# EasyEDA Pro project BlueberryPi.eprj, schematic BlueberryPi Board, sheets 1 to 8 of 13 (continued)
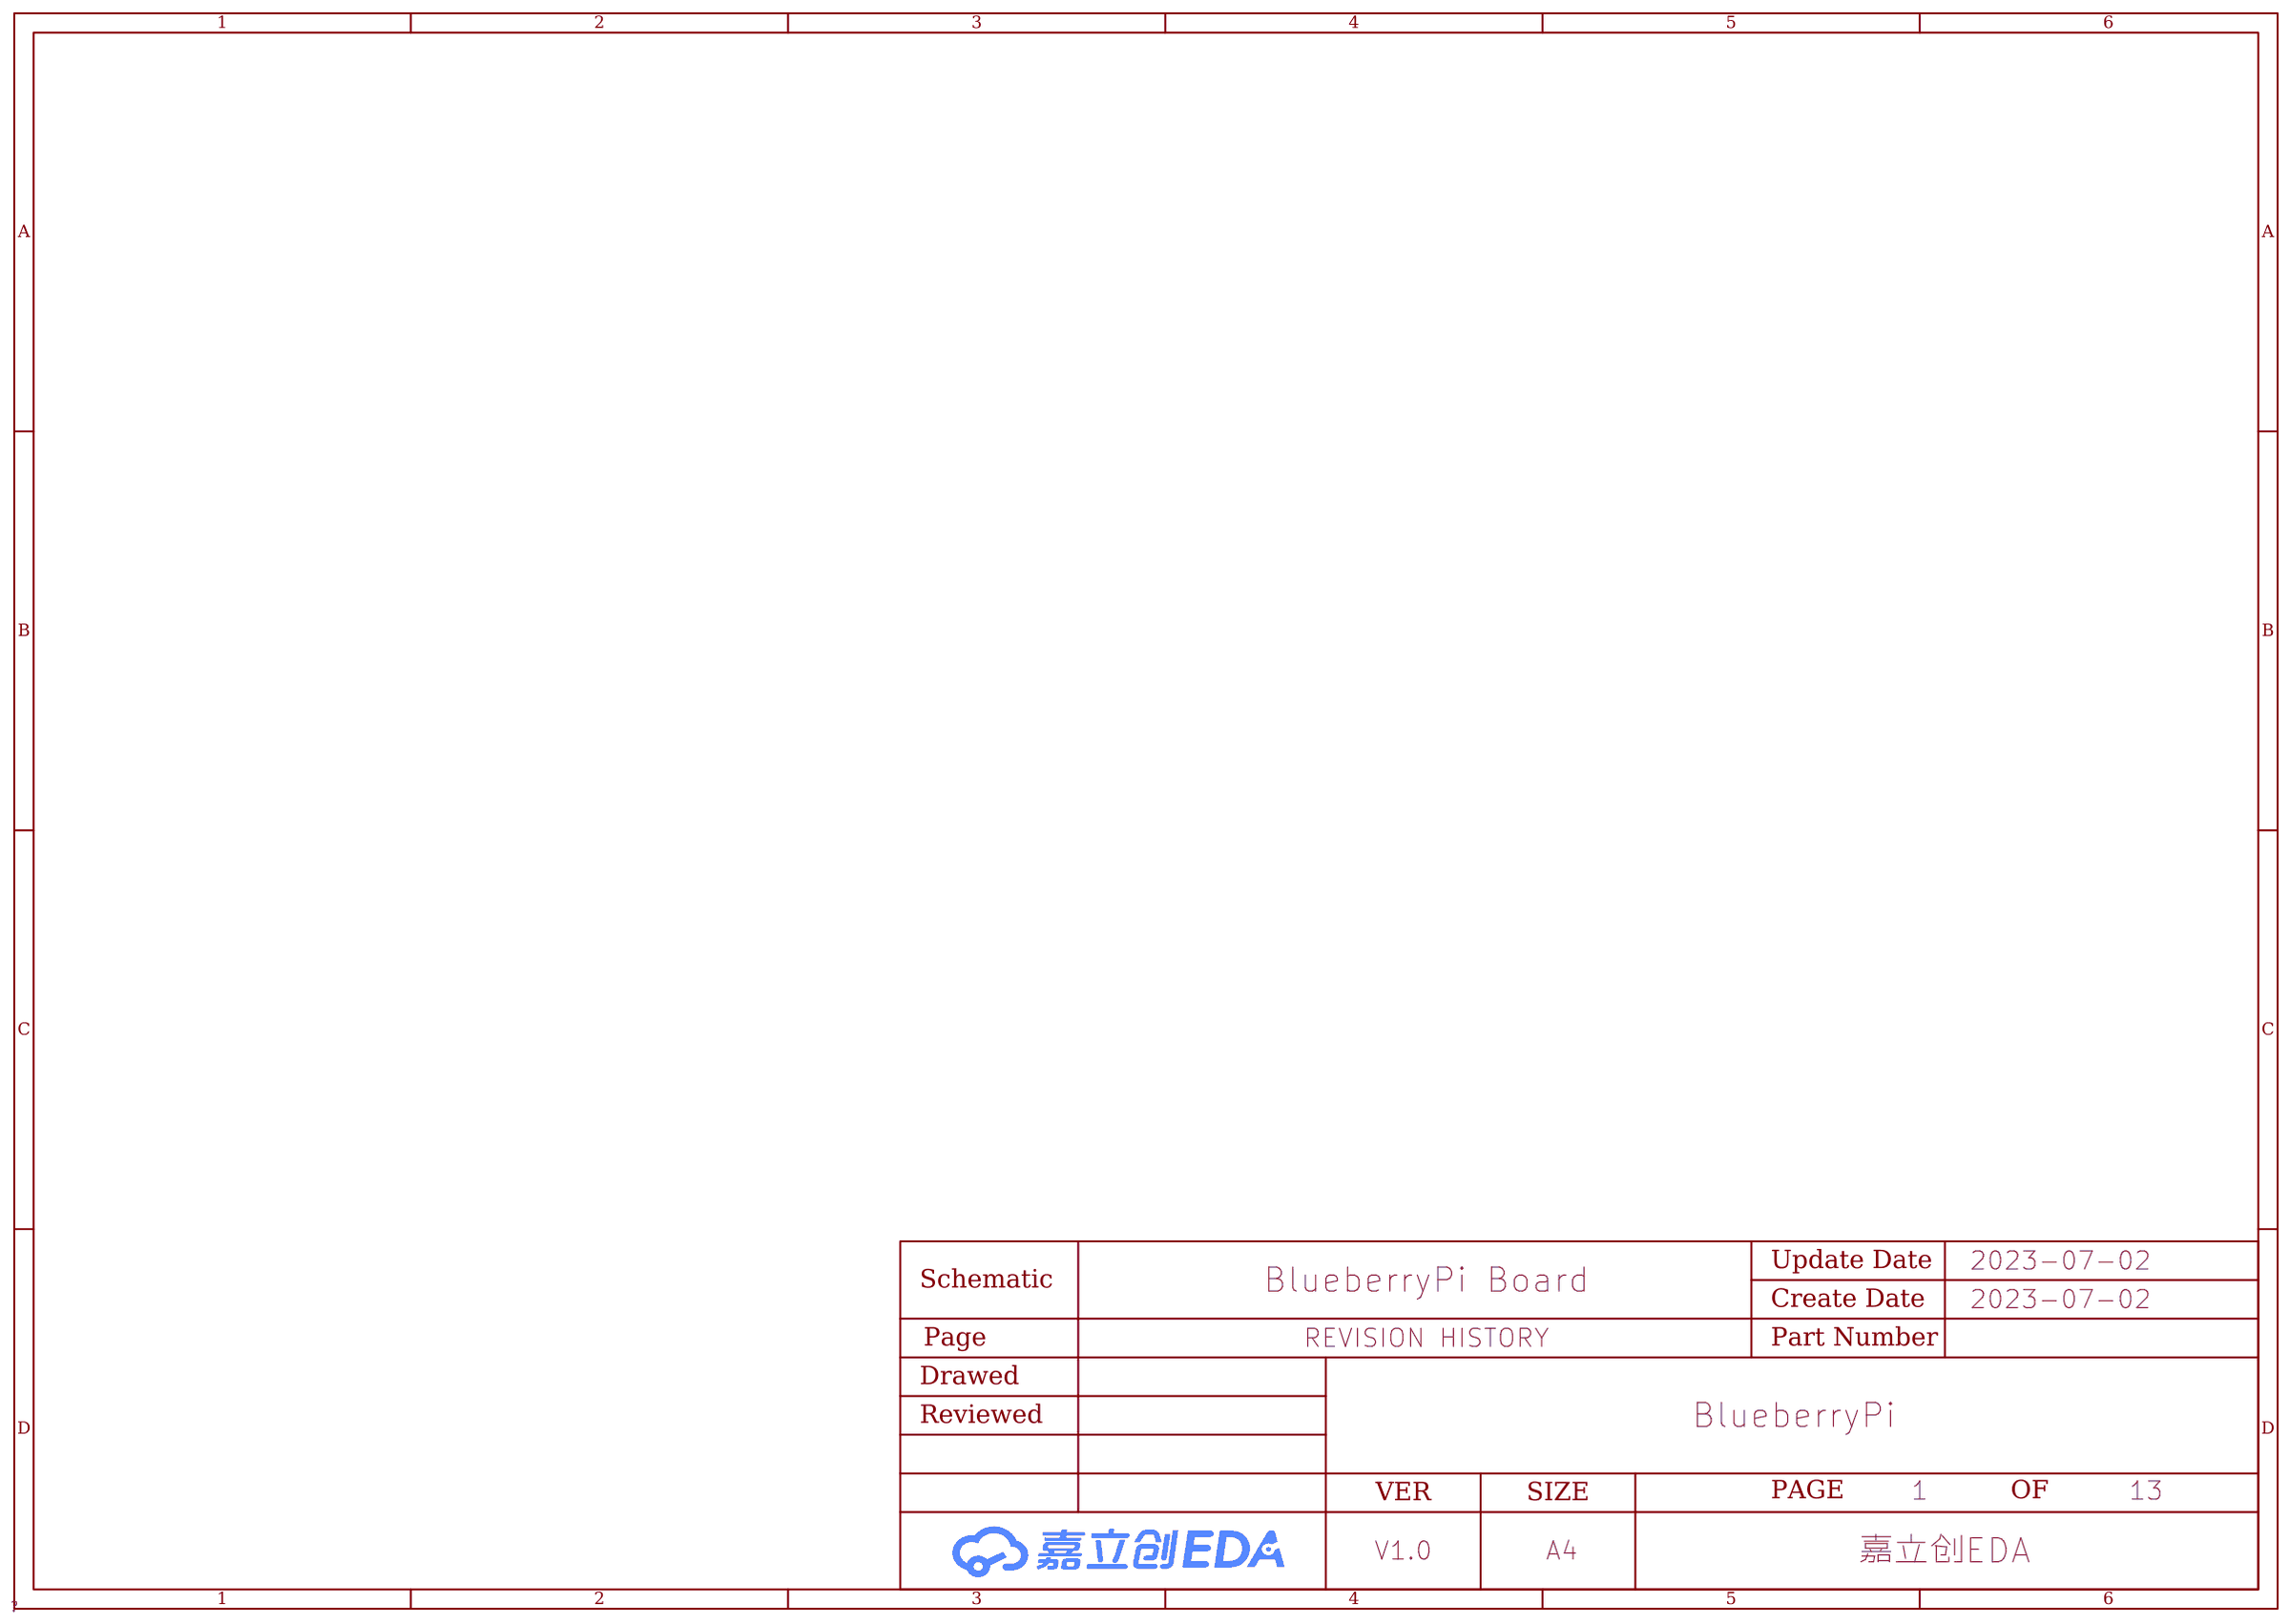
[diagram p0: REVISION HISTORY]
## Library data of the parts
C1-C6 C12 C15 C16 C21 C22 C26 C27 C29 C30 C34 C35 C43 C45-C49 C51 C53-C59 C62-C65 C70-C72 C81-C88 C90 C93 = 0402B104K250NT: 容值:100nF;精度:±10%;额定电压:25V;材质(温度系数):X7R;; LCSC Part Name: 100nF ±10% 25V; Supplier Part: C56392; Manufacturer: FH(风华); Supplier Footprint: 0402; JLCPCB Part Class: Extended Part; Datasheet: https://atta.szlcsc.com/upload/public/pdf/source/20200305/C486355_26A10D38EF8C2A5C37091D0039909270.pdf; Supplier: LCSC; Tolerance: ±10%; Voltage Rated: 25V; Temperature Coefficient: X7R
C17 C18 C23 C33 C37 C60 C77 C92 C97-C101 C105-C109 C111-C118 = GRM188R61E106KA73D: 容值:10uF;精度:±10%;额定电压:25V;材质(温度系数):X5R;; LCSC Part Name: 10uF ±10% 25V; Supplier Part: C344022; Manufacturer: muRata(村田); Supplier Footprint: 0603; JLCPCB Part Class: Extended Part; Datasheet: https://atta.szlcsc.com/upload/public/pdf/source/20181211/C344022_BB98D43E7DA95E5A749FBFE073C8A3E0.pdf; Supplier: LCSC; Tolerance: ±10%; Voltage Rated: 25V; Temperature Coefficient: X5R
C9 C11 C13 C14 C19 C20 C24 C25 C28 C32 C50 C61 C78-C80 C89 C96 = CL05A105KA5NQNC: 容值:1uF;精度:±10%;额定电压:25V;材质(温度系数):X5R;; LCSC Part Name: 1uF ±10% 25V; Supplier Part: C52923; Manufacturer: SAMSUNG(三星); Supplier Footprint: 0402; JLCPCB Part Class: Basic Part; Datasheet: https://atta.szlcsc.com/upload/public/pdf/source/20160103/1457707735223.pdf; Supplier: LCSC; Tolerance: ±10%; Voltage Rated: 25V; Temperature Coefficient: X5R
C66 C74 = CAP_0603: Supplier Footprint: 0603; Check: false
C67-C69 C73 C75 C76 = CAP_0402: Supplier Footprint: 0402; Check: false
R18 R19 = 0402WGF2400TCE: 电阻类型:厚膜电阻;阻值:240Ω;精度:±1%;功率:62.5mW;; LCSC Part Name: 240Ω ±1% 62.5mW; Supplier Part: C25094; Manufacturer: UNI-ROYAL(厚声); Supplier Footprint: 0402; JLCPCB Part Class: Extended Part; Datasheet: https://atta.szlcsc.com/upload/public/pdf/source/20200306/C422600_1E6D84923E4A46A82E41ADD87F860B5C.pdf; Supplier: LCSC; Type: 厚膜电阻; Tolerance: ±1%; Power(Watts): 62.5mW; Temperature Coefficient: ±100ppm/℃; Overload Voltage (Max): 50V; Operating Temperature Range: -55℃~+155℃
R9 R10 R20 R21 R23 R38-R40 = 0402WGF2001TCE: 电阻类型:厚膜电阻;阻值:2kΩ;精度:±1%;功率:62.5mW;; LCSC Part Name: 2kΩ ±1% 62.5mW; Supplier Part: C4109; Manufacturer: UNI-ROYAL(厚声); Supplier Footprint: 0402; JLCPCB Part Class: Basic Part; Datasheet: https://atta.szlcsc.com/upload/public/pdf/source/20200306/C422600_1E6D84923E4A46A82E41ADD87F860B5C.pdf; Supplier: LCSC; Type: 厚膜电阻; Tolerance: ±1%; Power(Watts): 62.5mW; Temperature Coefficient: ±100ppm/℃; Overload Voltage (Max): 50V; Operating Temperature Range: -55℃~+155℃
R22 = 0402WGF1501TCE: 电阻类型:厚膜电阻;阻值:1.5kΩ;精度:±1%;功率:62.5mW;; LCSC Part Name: 1.5kΩ ±1% 62.5mW; Supplier Part: C25867; Manufacturer: UNI-ROYAL(厚声); Supplier Footprint: 0402; JLCPCB Part Class: Basic Part; Datasheet: https://atta.szlcsc.com/upload/public/pdf/source/20200306/C422600_1E6D84923E4A46A82E41ADD87F860B5C.pdf; Supplier: LCSC; Type: 厚膜电阻; Tolerance: ±1%; Power(Watts): 62.5mW; Temperature Coefficient: ±100ppm/℃; Overload Voltage (Max): 50V; Operating Temperature Range: -55℃~+155℃
R24 = 0402WGF1000TCE: 电阻类型:厚膜电阻;阻值:100Ω;精度:±1%;功率:62.5mW;; LCSC Part Name: 100Ω ±1% 62.5mW; Supplier Part: C25076; Manufacturer: UNI-ROYAL(厚声); Supplier Footprint: 0402; JLCPCB Part Class: Basic Part; Datasheet: https://atta.szlcsc.com/upload/public/pdf/source/20200306/C422600_1E6D84923E4A46A82E41ADD87F860B5C.pdf; Supplier: LCSC; Type: 厚膜电阻; Tolerance: ±1%; Power(Watts): 62.5mW; Temperature Coefficient: ±200ppm/℃; Overload Voltage (Max): 50V; Operating Temperature Range: -55℃~+155℃
U35 = LPDDR3-2G: LCSC Part Name: K4E6E304EC-EGCG; Supplier Part: C2803256; Manufacturer: SAMSUNG(三星半导体); Manufacturer Part: K4E6E304EC-EGCG; Supplier Footprint: SMD; JLCPCB Part Class: 扩展库; Datasheet: https://atta.szlcsc.comnull; Supplier: LCSC
C91 = CL21A226MAYNNNE: 容值:22uF;精度:±20%;额定电压:25V;材质(温度系数):X5R;; LCSC Part Name: 22uF ±20% 25V; Supplier Part: C602037; Manufacturer: SAMSUNG(三星); Supplier Footprint: 0805; JLCPCB Part Class: Extended Part; Datasheet: https://atta.szlcsc.com/upload/public/pdf/source/20200609/C602037_1A0D619693E608A1BF6E80154254E2DB.pdf; Supplier: LCSC; Tolerance: ±20%; Voltage Rated: 25V; Temperature Coefficient: X5R
C7 C8 C94 = CC0402KRX7R9BB102: 容值:1nF;精度:±10%;额定电压:50V;材质(温度系数):X7R;; LCSC Part Name: 1nF ±10% 50V; Supplier Part: C106205; Manufacturer: YAGEO(国巨); Supplier Footprint: 0402; JLCPCB Part Class: Extended Part; Datasheet: https://atta.szlcsc.com/upload/public/pdf/source/20171226/C106205_15142609593391205665.pdf; Supplier: LCSC; Tolerance: ±10%; Voltage Rated: 50V; Temperature Coefficient: X7R
C10 C31 C38 C95 C102-C104 = CL10A475KA8NQNC: 容值:4.7uF;精度:±10%;额定电压:25V;材质(温度系数):X5R;; LCSC Part Name: 4.7uF ±10% 25V; Supplier Part: C69335; Manufacturer: SAMSUNG(三星); Supplier Footprint: 0603; JLCPCB Part Class: Extended Part; Datasheet: https://atta.szlcsc.com/upload/public/pdf/source/20161108/1478586410580.pdf; Supplier: LCSC; Tolerance: ±10%; Voltage Rated: 25V; Temperature Coefficient: X5R
C110 = 0603B104K500NT: 容值:100nF;精度:±10%;额定电压:50V;材质(温度系数):X7R;; LCSC Part Name: 100nF ±10% 50V; Supplier Part: C30926; Manufacturer: FH(风华); Supplier Footprint: 0603; JLCPCB Part Class: Extended Part; Datasheet: https://atta.szlcsc.com/upload/public/pdf/source/20170923/C30926_1506149436298988724.pdf; Supplier: LCSC; Tolerance: ±10%; Voltage Rated: 50V; Temperature Coefficient: X7R
D1 = SMAJ5.0A: 极性:单向;反向截止电压(Vrwm):5V;击穿电压(最小值):6.4V;击穿电压(最大值):7V;反向漏电流(Ir):800A;峰值脉冲电流(Ipp)@10/1000s:43.5A;最大钳位电压:9.2V;; LCSC Part Name: 单向 Vrwm:5V; Supplier Part: C908198; Manufacturer: FUXINSEMI(富芯森美); Supplier Footprint: SMA(DO-214AC); JLCPCB Part Class: 扩展库; Datasheet: https://atta.szlcsc.com/upload/public/pdf/source/20201023/C908195_37902766E86D5E1EA357B63C628FE5CE.pdf; Supplier: LCSC; Polarity: 单向; Reverse Stand-Off Voltage (Vrwm): 5V; Breakdown Voltage (Min): 6.4V; Breakdown Voltage (Max): 7V; Reverse Leakage Current (Ir): 800A; Peak Pulse Current (Ipp)@10/1000μs: 43.5A; Maximum Clamping Voltage: 9.2V
L1-L5 = SWPA4030S1R5NT: 额定电流:3.34A;精度:±20%;电感值:1.5uH;直流电阻(DCR):26mΩ;; LCSC Part Name: 1.5uH ±20%; Supplier Part: C42100; Manufacturer: Sunlord(顺络); Supplier Footprint: SMD; JLCPCB Part Class: 扩展库; Datasheet: https://atta.szlcsc.com/upload/public/pdf/source/20150713/1457707326143.pdf; Supplier: LCSC; Rated Current: 3.34A; Tolerance: ±20%; Height: 3mm; DC Resistance (DCR): 26mΩ; Width: 4mm; Length: 4mm
R26 R33 = 0603WAF0000T5E: 温度系数:-;精度:±1%;阻值:0Ω;功率:1/10W;最大工作电压:75V;工作温度范围:-55~+155;; LCSC Part Name: 0Ω ±1%; Supplier Part: C21189; Manufacturer: UNI-ROYAL(厚声); Supplier Footprint: 0603; JLCPCB Part Class: 基础库; Datasheet: https://atta.szlcsc.com/upload/public/pdf/source/20170920/C21189_1505887441435980537.pdf; Supplier: LCSC; Tolerance: ±1%; Power(Watts): 1/10W; Overload Voltage (Max): 75V; Operating Temperature Range: -55~+155
R32 R34 R36 = 0603WAF0000T5E: 温度系数:-;精度:±1%;阻值:0Ω;功率:1/10W;最大工作电压:75V;工作温度范围:-55~+155;; LCSC Part Name: 0Ω ±1%; Supplier Part: C21189; Manufacturer: UNI-ROYAL(厚声); Supplier Footprint: 0603; JLCPCB Part Class: 基础库; Datasheet: https://atta.szlcsc.com/upload/public/pdf/source/20170920/C21189_1505887441435980537.pdf; Supplier: LCSC; Tolerance: ±1%; Power(Watts): 1/10W; Overload Voltage (Max): 75V; Operating Temperature Range: -55~+155; Check: false
R35 = 0603WAF0000T5E: 电阻类型:厚膜电阻;阻值:0Ω;精度:±1%;功率:100mW;; LCSC Part Name: 0Ω ±1% 100mW; Supplier Part: C21189; Manufacturer: UNI-ROYAL(厚声); Supplier Footprint: 0603; JLCPCB Part Class: Basic Part; Datasheet: https://atta.szlcsc.com/upload/public/pdf/source/20200306/C422600_1E6D84923E4A46A82E41ADD87F860B5C.pdf; Supplier: LCSC; Type: 厚膜电阻; Tolerance: ±1%; Power(Watts): 100mW; Overload Voltage (Max): 75V; Operating Temperature Range: -55℃~+155℃; Check: false
R3 R16 R37 R41 = 0402WGF0000TCE: 电阻类型:厚膜电阻;阻值:0Ω;精度:±1%;功率:62.5mW;; LCSC Part Name: 0Ω ±1% 62.5mW; Supplier Part: C17168; Manufacturer: UNI-ROYAL(厚声); Supplier Footprint: 0402; JLCPCB Part Class: Basic Part; Datasheet: https://atta.szlcsc.com/upload/public/pdf/source/20200306/C422600_1E6D84923E4A46A82E41ADD87F860B5C.pdf; Supplier: LCSC; Type: 厚膜电阻; Tolerance: ±1%; Power(Watts): 62.5mW; Temperature Coefficient: ±800ppm/℃; Overload Voltage (Max): 50V; Operating Temperature Range: -55℃~+155℃
U37 = AXP805: Check: false
U38 = TP-红色测试点: Supplier Part: C9900007423; Supplier Footprint: TESTPOINT-TH_BD-2P-P2.00; JLCPCB Part Class: 扩展库; Datasheet: https://atta.szlcsc.comnull; Supplier: LCSC
USB1 = U-F-M5DS-Y-1: 连接器类型:Micro-B;标准:USB 2;公母:母座;触点数量:5;端口数量:1;; Supplier Part: C106818; Manufacturer: 韩国韩荣; JLCPCB Part Class: Extended Part; Supplier: LCSC; Connector Type: Micro-B; Standard: USB 2; Gender: 母座; Number of Contacts: 5; Number of Ports: 1
R1 R2 R94 = 0603WAF330JT5E: 电阻类型:厚膜电阻;阻值:33Ω;精度:±1%;功率:100mW;; LCSC Part Name: 33Ω ±1% 100mW; Supplier Part: C23140; Manufacturer: UNI-ROYAL(厚声); Supplier Footprint: 0603; JLCPCB Part Class: Basic Part; Datasheet: https://atta.szlcsc.com/upload/public/pdf/source/20200306/C422600_1E6D84923E4A46A82E41ADD87F860B5C.pdf; Supplier: LCSC; Type: 厚膜电阻; Tolerance: ±1%; Power(Watts): 100mW; Temperature Coefficient: ±100ppm/℃; Overload Voltage (Max): 75V; Operating Temperature Range: -55℃~+155℃
R4 R11 R13 R15 = 0402WGF1002TCE: 电阻类型:厚膜电阻;阻值:10kΩ;精度:±1%;功率:62.5mW;; LCSC Part Name: 10kΩ ±1% 62.5mW; Supplier Part: C25744; Manufacturer: UNI-ROYAL(厚声); Supplier Footprint: 0402; JLCPCB Part Class: Basic Part; Datasheet: https://atta.szlcsc.com/upload/public/pdf/source/20200306/C422600_1E6D84923E4A46A82E41ADD87F860B5C.pdf; Supplier: LCSC; Type: 厚膜电阻; Tolerance: ±1%; Power(Watts): 62.5mW; Temperature Coefficient: ±100ppm/℃; Overload Voltage (Max): 50V; Operating Temperature Range: -55℃~+155℃
R5 R12 = 0402WGF1001TCE: 电阻类型:厚膜电阻;阻值:1kΩ;精度:±1%;功率:62.5mW;; LCSC Part Name: 1kΩ ±1% 62.5mW; Supplier Part: C11702; Manufacturer: UNI-ROYAL(厚声); Supplier Footprint: 0402; JLCPCB Part Class: Basic Part; Datasheet: https://atta.szlcsc.com/upload/public/pdf/source/20200306/C422600_1E6D84923E4A46A82E41ADD87F860B5C.pdf; Supplier: LCSC; Type: 厚膜电阻; Tolerance: ±1%; Power(Watts): 62.5mW; Temperature Coefficient: ±100ppm/℃; Overload Voltage (Max): 50V; Operating Temperature Range: -55℃~+155℃
R7 = 0402WGF330JTCE: 电阻类型:厚膜电阻;阻值:33Ω;精度:±1%;功率:62.5mW;; LCSC Part Name: 33Ω ±1% 62.5mW; Supplier Part: C25105; Manufacturer: UNI-ROYAL(厚声); Supplier Footprint: 0402; JLCPCB Part Class: Basic Part; Datasheet: https://atta.szlcsc.com/upload/public/pdf/source/20200306/C422600_1E6D84923E4A46A82E41ADD87F860B5C.pdf; Supplier: LCSC; Type: 厚膜电阻; Tolerance: ±1%; Power(Watts): 62.5mW; Temperature Coefficient: ±100ppm/℃; Overload Voltage (Max): 50V; Operating Temperature Range: -55℃~+155℃
U1 = Allwinner_H6: 全志H6
C39 C40 = CL10C120JB8NNNC: 温度系数:C0G;容值:12pF;精度:±5%;额定电压:50V;; LCSC Part Name: 12pF(120) ±5% 50V; Supplier Part: C38523; Manufacturer: SAMSUNG(三星); Supplier Footprint: 0603; JLCPCB Part Class: 基础库; Datasheet: https://atta.szlcsc.com/upload/public/pdf/source/20160103/1457707725436.pdf; Supplier: LCSC; Temperature Coefficient: C0G; Tolerance: ±5%; Voltage Rated: 50V
C41 C42 = 0603CG7R0C500NT: 温度系数:C0G;精度:±0.25pF;容值:7pF;额定电压:50V;; LCSC Part Name: 7.0pF(7R0) ±0.25pF 50V; Supplier Part: C1682; Manufacturer: FH(风华); Supplier Footprint: 0603; JLCPCB Part Class: 扩展库; Datasheet: https://atta.szlcsc.com/upload/public/pdf/source/20170923/C1682_1506149316801988467.pdf; Supplier: LCSC; Temperature Coefficient: C0G; Tolerance: ±0.25pF; Voltage Rated: 50V
C44 = 0402B224K160NT: 容值:220nF;精度:±10%;额定电压:16V;材质(温度系数):X7R;; LCSC Part Name: 220nF ±10% 16V; Supplier Part: C192432; Manufacturer: FH(风华); Supplier Footprint: 0402; JLCPCB Part Class: Extended Part; Supplier: LCSC; Tolerance: ±10%; Voltage Rated: 16V; Temperature Coefficient: X7R
C52 = GRM155R61A475KEAAD: 容值:4.7uF;精度:±10%;额定电压:10V;材质(温度系数):X5R;; LCSC Part Name: 4.7uF ±10% 10V; Supplier Part: C77004; Manufacturer: muRata(村田); Supplier Footprint: 0402; JLCPCB Part Class: Extended Part; Datasheet: https://atta.szlcsc.com/upload/public/pdf/source/20180530/C77004_91929C63010077E63086B316CEEA6E6A.pdf; Supplier: LCSC; Tolerance: ±10%; Voltage Rated: 10V; Temperature Coefficient: X5R
R8 = PTFR0402B6K04N9: 电阻类型:薄膜电阻;阻值:6.04kΩ;精度:±0.1%;功率:60mW;温度系数:±10ppm/℃;; LCSC Part Name: 薄膜电阻 6.04kΩ ±0.1% 60mW; Supplier Part: C2692942; Manufacturer: RESI(开步睿思）; Supplier Footprint: 0402; JLCPCB Part Class: Extended Part; Datasheet: https://atta.szlcsc.com/upload/public/pdf/source/20210312/C2692860_0B6649DBA3C867366D8AF92C78953B08.pdf; Supplier: LCSC; Type: 薄膜电阻; Tolerance: ±0.1%; Power(Watts): 60mW; Temperature Coefficient: ±10ppm/℃; Overload Voltage (Max): 75V; Operating Temperature Range: -55℃~+125℃
R14 = 0402WGF1503TCE: 电阻类型:厚膜电阻;阻值:150kΩ;精度:±1%;功率:62.5mW;; LCSC Part Name: 150kΩ ±1% 62.5mW; Supplier Part: C25755; Manufacturer: UNI-ROYAL(厚声); Supplier Footprint: 0402; JLCPCB Part Class: Basic Part; Datasheet: https://atta.szlcsc.com/upload/public/pdf/source/20200306/C422600_1E6D84923E4A46A82E41ADD87F860B5C.pdf; Supplier: LCSC; Type: 厚膜电阻; Tolerance: ±1%; Power(Watts): 62.5mW; Temperature Coefficient: ±100ppm/℃; Overload Voltage (Max): 50V; Operating Temperature Range: -55℃~+155℃
R17 = 0402WGF1005TCE: LCSC Part Name: 10MΩ(1005) ±1% 编带; Supplier Part: C26082; Manufacturer: UNI-ROYAL(厚声); Supplier Footprint: 0402; JLCPCB Part Class: Basic Part; Datasheet: https://atta.szlcsc.com/upload/public/pdf/source/20170920/C26082_1505895182245981068.pdf; Supplier: LCSC
U4 = ESD5451N: Supplier: LCSC; Datasheet: https://atta.szlcsc.com/upload/public/pdf/source/20211227/D040CF3F0222548C5BD9F7E690946783.pdf; Manufacturer: TECH PUBLIC(台舟); Supplier Part: C2936977; JLCPCB Part Class: 扩展库; Check: false
X1 = X322524MOB4SI: 晶振类型:贴片无源晶振;频率:24MHz;频率公差:±10ppm;频率稳定度:±30ppm;负载电容:12pF;工作温度:-40~+85;; LCSC Part Name: 24MHz ±10ppm 12pF; Supplier Part: C70590; Manufacturer: YXC(扬兴晶振); Supplier Footprint: SMD3225-4P; JLCPCB Part Class: 扩展库; Datasheet: https://atta.szlcsc.com/upload/public/pdf/source/20210329/C112971_1F611BDC486E193C1706F6D8EB5AA189.pdf; Supplier: LCSC; Crystal Type: 贴片无源晶振; Frequency Tolerance: ±10ppm; Frequency Stability: ±30ppm; Load Capacitance: 12pF; Operating Temperature: -40~+85
X2 = MC-14632.768kHz7.0pF20PPM: 晶振类型:贴片无源晶振;频率:32.768kHz;频率公差:±20ppm;负载电容:7pF;等效串联电阻(ESR):65kΩ;工作温度:-40~+85;; LCSC Part Name: 32.768kHz ±20ppm 7pF; Supplier Part: C94977; Manufacturer: EPSON(爱普生); Supplier Footprint: MC-146; JLCPCB Part Class: 扩展库; Datasheet: https://atta.szlcsc.com/upload/public/pdf/source/20170211/1486785670215.pdf; Supplier: LCSC; Crystal Type: 贴片无源晶振; Frequency Tolerance: ±20ppm; Load Capacitance: 7pF; Equivalent Series Resistance (ESR): 65kΩ; Operating Temperature: -40~+85

## Nets
GND: C1.1 C2.1 C3.1 C4.1 C7.2 C8.2 C9.2 C10.1 C11.1 C12.1 C13.1 C14.1 C15.1 C16.1 C17.1 C18.1 C19.1 C20.1 C21.1 C22.1 C23.1 C24.1 C25.1 C26.1 C27.1 C28.1 C29.1 C30.1 C31.1 C32.1 C33.1 C34.1 C35.1 C37.1 C38.1 C39.2 C40.2 C41.2 C42.2 C43.1 C44.1 C45.1 C46.1 C47.1 C48.1 C49.1 C50.1 C51.1 C52.1 C53.1 C54.1 C55.1 C56.1 C57.1 C58.1 C59.1 C60.1 C61.1 C62.1 C63.1 C64.1 C65.1 C66.1 C67.1 C68.1 C69.1 C70.1 C71.1 C72.1 C73.1 C74.1 C75.1 C76.1 C77.1 C78.1 C79.1 C80.1 C81.1 C82.1 C83.1 C84.1 C85.1 C86.1 C87.1 C88.1 C89.1 C90.1 C91.1 C92.1 C93.1 C94.1 C95.1 C96.1 C97.1 C98.1 C99.1 C100.1 C101.1 C102.1 C103.1 C104.1 C105.1 C106.1 C107.1 C108.1 C109.2 C110.1 C111.2 C112.1 C113.2 C114.1 C115.2 C116.1 C117.2 C118.1 D1.2(A) R8.1 R14.2 R15.2 R18.1 R19.2 R21.1 R23.1 U1.A1(AGND1) U1.A16(GND2) U1.A21(GND3) U1.A23(GND4) U1.AA4(SRAS/SA16) U1.AA8(GND140) U1.AA11(SACT) U1.AA14(SWE/SA14) U1.AA16(GND141) U1.AA20(SBA1) U1.AA21(GND142) U1.AB3(GND143) U1.AB13(GND144) U1.AB21(GND145) U1.AC1(GND146) U1.AC5(GND147) U1.AC11(GND148) U1.AC19(GND149) U1.AC23(GND150) U1.C12(GND6) U1.C13(GND7) U1.C14(GND8) U1.C18(GND9) U1.C22(GND10) U1.D23(GND11) U1.E1(AGND2) U1.E3(AGND3) U1.E5(AGND4) U1.E13(GND17) U1.E15(GND18) U1.E16(GND19) U1.E18(GND20) U1.F12(GND21) U1.F13(GND22) U1.F14(GND23) U1.F15(GND24) U1.F16(GND25) U1.F17(GND26) U1.F21(GND27) U1.G7(GND1) U1.G9(GND28) U1.G15(GND29) U1.H1(GND30) U1.H7(GND31) U1.H8(GND32) U1.H9(GND33) U1.H10(GND34) U1.H12(GND35) U1.H15(GND36) U1.H16(GND37) U1.H23(GND38) U1.J7(GND39) U1.J8(GND40) U1.J9(GND41) U1.J10(GND42) U1.J11(GND43) U1.J12(GND44) U1.J15(GND45) U1.J16(GND46) U1.J17(GND47) U1.K7(GND48) U1.K8(GND49) U1.K9(GND50) U1.K10(GND51) U1.K11(GND52) U1.K12(GND53) U1.K13(GND54) U1.K14(GND55) U1.K15(GND56) U1.K16(GND57) U1.K17(GND58) U1.L7(GND59) U1.L9(GND60) U1.L10(GND61) U1.L11(GND62) U1.L12(GND63) U1.L13(GND64) U1.L14(GND65) U1.L15(GND66) U1.L18(GND67) U1.M1(GND68) U1.M7(GND69) U1.M10(GND70) U1.M11(GND71) U1.M12(GND72) U1.M13(GND73) U1.M14(GND74) U1.M15(GND75) U1.M18(GND76) U1.M23(GND77) U1.N7(GND78) U1.N10(GND79) U1.N11(GND80) U1.N12(GND81) U1.N13(GND82) U1.N14(GND83) U1.N15(GND84) U1.N18(GND85) U1.P7(GND86) U1.P10(GND87) U1.P11(GND88) U1.P12(GND89) U1.P13(GND90) U1.P14(GND91) U1.P20(GND92) U1.R8(GND93) U1.R9(GND94) U1.R10(GND95) U1.R11(GND96) U1.R12(GND97) U1.R13(GND98) U1.R14(GND99) U1.R15(GND100) U1.R17(GND101) U1.R18(GND102) U1.T7(GND103) U1.T8(GND104) U1.T9(GND105) U1.T10(GND106) U1.T11(GND107) U1.T12(GND108) U1.T13(GND109) U1.T14(GND110) U1.T15(GND111) U1.T16(GND112) U1.T18(GND113) U1.T19(GND114) U1.U6(GND115) U1.U7(GND116) U1.U9(GND117) U1.U10(GND118) U1.U11(GND119) U1.U12(GND120) U1.U15(GND121) U1.U17(GND122) U1.U18(GND123) U1.U22(GND124) U1.U23(GND125) U1.V5(GND126) U1.V7(GND127) U1.V13(GND128) U1.V17(GND129) U1.V19(GND130) U1.V20(GND131) U1.W1(GND132) U1.W3(GND133) U1.W5(SA13) U1.W7(SBA0) U1.W8(SBG0) U1.W10(GND134) U1.W16(SA12) U1.W17(SA11) U1.W19(SCAS/SA15) U1.W21(GND135) U1.W23(GND136) U1.Y5(GND137) U1.Y7(SA17) U1.Y13(GND138) U1.Y17(SA10) U1.Y19(GND139) U4.1(K) U35.B2(VSS) U35.B5(VSS) U35.B6(VSSQ) U35.B12(VSSQ) U35.C3(VSSCA) U35.C5(VSS) U35.C6(VSSQ) U35.D3(VSSCA) U35.D12(VSSQ) U35.E4(VSS) U35.E5(VSS) U35.E6(VSSQ) U35.F4(VSSCA) U35.F5(VSS) U35.F6(VSSQ) U35.F12(VSSQ) U35.G3(VSSCA) U35.G4(VSSCA) U35.G6(VDDQ) U35.G9(VSSQ) U35.H2(VSS) U35.H10(VSSQ) U35.J4(VSSCA) U35.J12(VSS) U35.K2(VSS) U35.K10(VSSQ) U35.L6(VSS) U35.L9(VSSQ) U35.M4(VSSCA) U35.M5(VSS) U35.M6(VSSQ) U35.M12(VSSQ) U35.N4(VSS) U35.N5(VSS) U35.N6(VSSQ) U35.P3(VSSCA) U35.P12(VSSQ) U35.R4(VSS) U35.R5(VSS) U35.R6(VSSQ) U35.T2(VSS) U35.T3(VSS) U35.T4(VSS) U35.T5(VSS) U35.T6(VSSQ) U35.T12(VSSQ) U37.8(PGNDD) U37.11(PGNDE) U37.37(PGNDB_1) U37.38(PGNDB_2) U37.41(PGNDA_2) U37.42(PGNDA_1) U37.48(PGNDC_2) U37.49(PGNDC_1) U37.54(FBGND) U37.57(GND) USB1.5(GND) USB1.6(EP) USB1.7(EP) USB1.8(EP) USB1.9(EP) X1.2(GND) X1.4(GND) X2.2 X2.3 ; also on sheet 9 10 11 12 13